# EAGLE schematic Resistor_Resistor (EAGLE 8.3.0), part 35 of 43
## Nets (continued)
N$94: R17001.2 R17002.2 R17003.2 R17004.2 R17005.2 R17006.2 R17007.2 R17008.2 R17009.2 R17010.2 R17011.2 R17012.2 R17013.2 R17014.2 R17015.2 R17016.2 R17017.2 R17018.2 R17019.2 R17020.2 R17021.2 R17022.2 R17023.2 R17024.2 R17025.2 R17026.2 R17027.2 R17028.2 R17029.2 R17030.2 R17031.2 R17032.2 R17033.2 R17034.2 R17035.2 R17036.2 R17037.2 R17038.2 R17039.2 R17040.2 R17041.2 R17042.2 R17043.2 R17044.2 R17045.2 R17046.2 R17047.2 R17048.2 R17049.2 R17050.2 R17051.2 R17052.2 R17053.2 R17054.2 R17055.2 R17056.2 R17057.2 R17058.2 R17059.2 R17060.2 R17061.2 R17062.2 R17063.2 R17064.2 R17065.2 R17066.2 R17067.2 R17068.2 R17069.2 R17070.2 R17071.2 R17072.2 R17073.2 R17074.2 R17075.2 R17076.2 R17077.2 R17078.2 R17079.2 R17080.2 R17081.2 R17082.2 R17083.2 R17084.2 R17085.2 R17086.2 R17087.2 R17088.2 R17089.2 R17090.2 R17091.2 R17092.2 R17093.2 R17094.2 R17095.2 R17096.2 R17097.2 R17098.2 R17099.2 R17100.2 R17101.2 R17102.2 R17103.2 R17104.2 R17105.2 R17106.2 R17107.2 R17108.2 R17109.2 R17110.2 R17111.2 R17112.2 R17113.2 R17114.2 R17115.2 R17116.2 R17117.2 R17118.2 R17119.2 R17120.2 R17121.2 R17122.2 R17123.2 R17124.2 R17125.2 R17126.2 R17127.2 R17128.2 R17129.2 R17130.2 R17131.2 R17132.2 R17133.2 R17134.2 R17135.2 R17136.2 R17137.2 R17138.2 R17139.2 R17140.2 R17141.2 R17142.2 R17143.2 R17144.2 R17145.2 R17146.2 R17147.2 R17148.2 R17149.2 R17150.2 R17151.2 R17152.2 R17153.2 R17154.2 R17155.2 R17156.2 R17157.2 R17158.2 R17159.2 R17160.2 R17161.2 R17162.2 R17163.2 R17164.2 R17165.2 R17166.2 R17167.2 R17168.2 R17169.2 R17170.2 R17171.2 R17172.2 R17173.2 R17174.2 R17175.2 R17176.2 R17177.2 R17178.2 R17179.2 R17180.2 R17181.2 R17182.2 R17183.2 R17184.2 R17185.2 R17186.2 R17187.2 R17188.2 R17189.2 R17190.2 R17191.2 R17192.2 R17193.2 R17194.2 R17195.2 R17196.2 R17197.2 R17198.2 R17199.2 R17200.2 R17201.1 R17202.1 R17203.1 R17204.1 R17205.1 R17206.1 R17207.1 R17208.1 R17209.1 R17210.1 R17211.1 R17212.1 R17213.1 R17214.1 R17215.1 R17216.1 R17217.1 R17218.1 R17219.1 R17220.1 R17221.1 R17222.1 R17223.1 R17224.1 R17225.1 R17226.1 R17227.1 R17228.1 R17229.1 R17230.1 R17231.1 R17232.1 R17233.1 R17234.1 R17235.1 R17236.1 R17237.1 R17238.1 R17239.1 R17240.1 R17241.1 R17242.1 R17243.1 R17244.1 R17245.1 R17246.1 R17247.1 R17248.1 R17249.1 R17250.1 R17251.1 R17252.1 R17253.1 R17254.1 R17255.1 R17256.1 R17257.1 R17258.1 R17259.1 R17260.1 R17261.1 R17262.1 R17263.1 R17264.1 R17265.1 R17266.1 R17267.1 R17268.1 R17269.1 R17270.1 R17271.1 R17272.1 R17273.1 R17274.1 R17275.1 R17276.1 R17277.1 R17278.1 R17279.1 R17280.1 R17281.1 R17282.1 R17283.1 R17284.1 R17285.1 R17286.1 R17287.1 R17288.1 R17289.1 R17290.1 R17291.1 R17292.1 R17293.1 R17294.1 R17295.1 R17296.1 R17297.1 R17298.1 R17299.1 R17300.1 R17301.1 R17302.1 R17303.1 R17304.1 R17305.1 R17306.1 R17307.1 R17308.1 R17309.1 R17310.1 R17311.1 R17312.1 R17313.1 R17314.1 R17315.1 R17316.1 R17317.1 R17318.1 R17319.1 R17320.1 R17321.1 R17322.1 R17323.1 R17324.1 R17325.1 R17326.1 R17327.1 R17328.1 R17329.1 R17330.1 R17331.1 R17332.1 R17333.1 R17334.1 R17335.1 R17336.1 R17337.1 R17338.1 R17339.1 R17340.1 R17341.1 R17342.1 R17343.1 R17344.1 R17345.1 R17346.1 R17347.1 R17348.1 R17349.1 R17350.1 R17351.1 R17352.1 R17353.1 R17354.1 R17355.1 R17356.1 R17357.1 R17358.1 R17359.1 R17360.1 R17361.1 R17362.1 R17363.1 R17364.1 R17365.1 R17366.1 R17367.1 R17368.1 R17369.1 R17370.1 R17371.1 R17372.1 R17373.1 R17374.1 R17375.1 R17376.1 R17377.1 R17378.1 R17379.1 R17380.1 R17381.1 R17382.1 R17383.1 R17384.1 R17385.1 R17386.1 R17387.1 R17388.1 R17389.1 R17390.1 R17391.1 R17392.1 R17393.1 R17394.1 R17395.1 R17396.1 R17397.1 R17398.1 R17399.1 R17400.1
N$95: R17201.2 R17202.2 R17203.2 R17204.2 R17205.2 R17206.2 R17207.2 R17208.2 R17209.2 R17210.2 R17211.2 R17212.2 R17213.2 R17214.2 R17215.2 R17216.2 R17217.2 R17218.2 R17219.2 R17220.2 R17221.2 R17222.2 R17223.2 R17224.2 R17225.2 R17226.2 R17227.2 R17228.2 R17229.2 R17230.2 R17231.2 R17232.2 R17233.2 R17234.2 R17235.2 R17236.2 R17237.2 R17238.2 R17239.2 R17240.2 R17241.2 R17242.2 R17243.2 R17244.2 R17245.2 R17246.2 R17247.2 R17248.2 R17249.2 R17250.2 R17251.2 R17252.2 R17253.2 R17254.2 R17255.2 R17256.2 R17257.2 R17258.2 R17259.2 R17260.2 R17261.2 R17262.2 R17263.2 R17264.2 R17265.2 R17266.2 R17267.2 R17268.2 R17269.2 R17270.2 R17271.2 R17272.2 R17273.2 R17274.2 R17275.2 R17276.2 R17277.2 R17278.2 R17279.2 R17280.2 R17281.2 R17282.2 R17283.2 R17284.2 R17285.2 R17286.2 R17287.2 R17288.2 R17289.2 R17290.2 R17291.2 R17292.2 R17293.2 R17294.2 R17295.2 R17296.2 R17297.2 R17298.2 R17299.2 R17300.2 R17301.2 R17302.2 R17303.2 R17304.2 R17305.2 R17306.2 R17307.2 R17308.2 R17309.2 R17310.2 R17311.2 R17312.2 R17313.2 R17314.2 R17315.2 R17316.2 R17317.2 R17318.2 R17319.2 R17320.2 R17321.2 R17322.2 R17323.2 R17324.2 R17325.2 R17326.2 R17327.2 R17328.2 R17329.2 R17330.2 R17331.2 R17332.2 R17333.2 R17334.2 R17335.2 R17336.2 R17337.2 R17338.2 R17339.2 R17340.2 R17341.2 R17342.2 R17343.2 R17344.2 R17345.2 R17346.2 R17347.2 R17348.2 R17349.2 R17350.2 R17351.2 R17352.2 R17353.2 R17354.2 R17355.2 R17356.2 R17357.2 R17358.2 R17359.2 R17360.2 R17361.2 R17362.2 R17363.2 R17364.2 R17365.2 R17366.2 R17367.2 R17368.2 R17369.2 R17370.2 R17371.2 R17372.2 R17373.2 R17374.2 R17375.2 R17376.2 R17377.2 R17378.2 R17379.2 R17380.2 R17381.2 R17382.2 R17383.2 R17384.2 R17385.2 R17386.2 R17387.2 R17388.2 R17389.2 R17390.2 R17391.2 R17392.2 R17393.2 R17394.2 R17395.2 R17396.2 R17397.2 R17398.2 R17399.2 R17400.2 R17401.1 R17402.1 R17403.1 R17404.1 R17405.1 R17406.1 R17407.1 R17408.1 R17409.1 R17410.1 R17411.1 R17412.1 R17413.1 R17414.1 R17415.1 R17416.1 R17417.1 R17418.1 R17419.1 R17420.1 R17421.1 R17422.1 R17423.1 R17424.1 R17425.1 R17426.1 R17427.1 R17428.1 R17429.1 R17430.1 R17431.1 R17432.1 R17433.1 R17434.1 R17435.1 R17436.1 R17437.1 R17438.1 R17439.1 R17440.1 R17441.1 R17442.1 R17443.1 R17444.1 R17445.1 R17446.1 R17447.1 R17448.1 R17449.1 R17450.1 R17451.1 R17452.1 R17453.1 R17454.1 R17455.1 R17456.1 R17457.1 R17458.1 R17459.1 R17460.1 R17461.1 R17462.1 R17463.1 R17464.1 R17465.1 R17466.1 R17467.1 R17468.1 R17469.1 R17470.1 R17471.1 R17472.1 R17473.1 R17474.1 R17475.1 R17476.1 R17477.1 R17478.1 R17479.1 R17480.1 R17481.1 R17482.1 R17483.1 R17484.1 R17485.1 R17486.1 R17487.1 R17488.1 R17489.1 R17490.1 R17491.1 R17492.1 R17493.1 R17494.1 R17495.1 R17496.1 R17497.1 R17498.1 R17499.1 R17500.1 R17501.1 R17502.1 R17503.1 R17504.1 R17505.1 R17506.1 R17507.1 R17508.1 R17509.1 R17510.1 R17511.1 R17512.1 R17513.1 R17514.1 R17515.1 R17516.1 R17517.1 R17518.1 R17519.1 R17520.1 R17521.1 R17522.1 R17523.1 R17524.1 R17525.1 R17526.1 R17527.1 R17528.1 R17529.1 R17530.1 R17531.1 R17532.1 R17533.1 R17534.1 R17535.1 R17536.1 R17537.1 R17538.1 R17539.1 R17540.1 R17541.1 R17542.1 R17543.1 R17544.1 R17545.1 R17546.1 R17547.1 R17548.1 R17549.1 R17550.1 R17551.1 R17552.1 R17553.1 R17554.1 R17555.1 R17556.1 R17557.1 R17558.1 R17559.1 R17560.1 R17561.1 R17562.1 R17563.1 R17564.1 R17565.1 R17566.1 R17567.1 R17568.1 R17569.1 R17570.1 R17571.1 R17572.1 R17573.1 R17574.1 R17575.1 R17576.1 R17577.1 R17578.1 R17579.1 R17580.1 R17581.1 R17582.1 R17583.1 R17584.1 R17585.1 R17586.1 R17587.1 R17588.1 R17589.1 R17590.1 R17591.1 R17592.1 R17593.1 R17594.1 R17595.1 R17596.1 R17597.1 R17598.1 R17599.1 R17600.1
N$96: R17401.2 R17402.2 R17403.2 R17404.2 R17405.2 R17406.2 R17407.2 R17408.2 R17409.2 R17410.2 R17411.2 R17412.2 R17413.2 R17414.2 R17415.2 R17416.2 R17417.2 R17418.2 R17419.2 R17420.2 R17421.2 R17422.2 R17423.2 R17424.2 R17425.2 R17426.2 R17427.2 R17428.2 R17429.2 R17430.2 R17431.2 R17432.2 R17433.2 R17434.2 R17435.2 R17436.2 R17437.2 R17438.2 R17439.2 R17440.2 R17441.2 R17442.2 R17443.2 R17444.2 R17445.2 R17446.2 R17447.2 R17448.2 R17449.2 R17450.2 R17451.2 R17452.2 R17453.2 R17454.2 R17455.2 R17456.2 R17457.2 R17458.2 R17459.2 R17460.2 R17461.2 R17462.2 R17463.2 R17464.2 R17465.2 R17466.2 R17467.2 R17468.2 R17469.2 R17470.2 R17471.2 R17472.2 R17473.2 R17474.2 R17475.2 R17476.2 R17477.2 R17478.2 R17479.2 R17480.2 R17481.2 R17482.2 R17483.2 R17484.2 R17485.2 R17486.2 R17487.2 R17488.2 R17489.2 R17490.2 R17491.2 R17492.2 R17493.2 R17494.2 R17495.2 R17496.2 R17497.2 R17498.2 R17499.2 R17500.2 R17501.2 R17502.2 R17503.2 R17504.2 R17505.2 R17506.2 R17507.2 R17508.2 R17509.2 R17510.2 R17511.2 R17512.2 R17513.2 R17514.2 R17515.2 R17516.2 R17517.2 R17518.2 R17519.2 R17520.2 R17521.2 R17522.2 R17523.2 R17524.2 R17525.2 R17526.2 R17527.2 R17528.2 R17529.2 R17530.2 R17531.2 R17532.2 R17533.2 R17534.2 R17535.2 R17536.2 R17537.2 R17538.2 R17539.2 R17540.2 R17541.2 R17542.2 R17543.2 R17544.2 R17545.2 R17546.2 R17547.2 R17548.2 R17549.2 R17550.2 R17551.2 R17552.2 R17553.2 R17554.2 R17555.2 R17556.2 R17557.2 R17558.2 R17559.2 R17560.2 R17561.2 R17562.2 R17563.2 R17564.2 R17565.2 R17566.2 R17567.2 R17568.2 R17569.2 R17570.2 R17571.2 R17572.2 R17573.2 R17574.2 R17575.2 R17576.2 R17577.2 R17578.2 R17579.2 R17580.2 R17581.2 R17582.2 R17583.2 R17584.2 R17585.2 R17586.2 R17587.2 R17588.2 R17589.2 R17590.2 R17591.2 R17592.2 R17593.2 R17594.2 R17595.2 R17596.2 R17597.2 R17598.2 R17599.2 R17600.2 R17601.1 R17602.1 R17603.1 R17604.1 R17605.1 R17606.1 R17607.1 R17608.1 R17609.1 R17610.1 R17611.1 R17612.1 R17613.1 R17614.1 R17615.1 R17616.1 R17617.1 R17618.1 R17619.1 R17620.1 R17621.1 R17622.1 R17623.1 R17624.1 R17625.1 R17626.1 R17627.1 R17628.1 R17629.1 R17630.1 R17631.1 R17632.1 R17633.1 R17634.1 R17635.1 R17636.1 R17637.1 R17638.1 R17639.1 R17640.1 R17641.1 R17642.1 R17643.1 R17644.1 R17645.1 R17646.1 R17647.1 R17648.1 R17649.1 R17650.1 R17651.1 R17652.1 R17653.1 R17654.1 R17655.1 R17656.1 R17657.1 R17658.1 R17659.1 R17660.1 R17661.1 R17662.1 R17663.1 R17664.1 R17665.1 R17666.1 R17667.1 R17668.1 R17669.1 R17670.1 R17671.1 R17672.1 R17673.1 R17674.1 R17675.1 R17676.1 R17677.1 R17678.1 R17679.1 R17680.1 R17681.1 R17682.1 R17683.1 R17684.1 R17685.1 R17686.1 R17687.1 R17688.1 R17689.1 R17690.1 R17691.1 R17692.1 R17693.1 R17694.1 R17695.1 R17696.1 R17697.1 R17698.1 R17699.1 R17700.1 R17701.1 R17702.1 R17703.1 R17704.1 R17705.1 R17706.1 R17707.1 R17708.1 R17709.1 R17710.1 R17711.1 R17712.1 R17713.1 R17714.1 R17715.1 R17716.1 R17717.1 R17718.1 R17719.1 R17720.1 R17721.1 R17722.1 R17723.1 R17724.1 R17725.1 R17726.1 R17727.1 R17728.1 R17729.1 R17730.1 R17731.1 R17732.1 R17733.1 R17734.1 R17735.1 R17736.1 R17737.1 R17738.1 R17739.1 R17740.1 R17741.1 R17742.1 R17743.1 R17744.1 R17745.1 R17746.1 R17747.1 R17748.1 R17749.1 R17750.1 R17751.1 R17752.1 R17753.1 R17754.1 R17755.1 R17756.1 R17757.1 R17758.1 R17759.1 R17760.1 R17761.1 R17762.1 R17763.1 R17764.1 R17765.1 R17766.1 R17767.1 R17768.1 R17769.1 R17770.1 R17771.1 R17772.1 R17773.1 R17774.1 R17775.1 R17776.1 R17777.1 R17778.1 R17779.1 R17780.1 R17781.1 R17782.1 R17783.1 R17784.1 R17785.1 R17786.1 R17787.1 R17788.1 R17789.1 R17790.1 R17791.1 R17792.1 R17793.1 R17794.1 R17795.1 R17796.1 R17797.1 R17798.1 R17799.1 R17800.1
N$97: R17601.2 R17602.2 R17603.2 R17604.2 R17605.2 R17606.2 R17607.2 R17608.2 R17609.2 R17610.2 R17611.2 R17612.2 R17613.2 R17614.2 R17615.2 R17616.2 R17617.2 R17618.2 R17619.2 R17620.2 R17621.2 R17622.2 R17623.2 R17624.2 R17625.2 R17626.2 R17627.2 R17628.2 R17629.2 R17630.2 R17631.2 R17632.2 R17633.2 R17634.2 R17635.2 R17636.2 R17637.2 R17638.2 R17639.2 R17640.2 R17641.2 R17642.2 R17643.2 R17644.2 R17645.2 R17646.2 R17647.2 R17648.2 R17649.2 R17650.2 R17651.2 R17652.2 R17653.2 R17654.2 R17655.2 R17656.2 R17657.2 R17658.2 R17659.2 R17660.2 R17661.2 R17662.2 R17663.2 R17664.2 R17665.2 R17666.2 R17667.2 R17668.2 R17669.2 R17670.2 R17671.2 R17672.2 R17673.2 R17674.2 R17675.2 R17676.2 R17677.2 R17678.2 R17679.2 R17680.2 R17681.2 R17682.2 R17683.2 R17684.2 R17685.2 R17686.2 R17687.2 R17688.2 R17689.2 R17690.2 R17691.2 R17692.2 R17693.2 R17694.2 R17695.2 R17696.2 R17697.2 R17698.2 R17699.2 R17700.2 R17701.2 R17702.2 R17703.2 R17704.2 R17705.2 R17706.2 R17707.2 R17708.2 R17709.2 R17710.2 R17711.2 R17712.2 R17713.2 R17714.2 R17715.2 R17716.2 R17717.2 R17718.2 R17719.2 R17720.2 R17721.2 R17722.2 R17723.2 R17724.2 R17725.2 R17726.2 R17727.2 R17728.2 R17729.2 R17730.2 R17731.2 R17732.2 R17733.2 R17734.2 R17735.2 R17736.2 R17737.2 R17738.2 R17739.2 R17740.2 R17741.2 R17742.2 R17743.2 R17744.2 R17745.2 R17746.2 R17747.2 R17748.2 R17749.2 R17750.2 R17751.2 R17752.2 R17753.2 R17754.2 R17755.2 R17756.2 R17757.2 R17758.2 R17759.2 R17760.2 R17761.2 R17762.2 R17763.2 R17764.2 R17765.2 R17766.2 R17767.2 R17768.2 R17769.2 R17770.2 R17771.2 R17772.2 R17773.2 R17774.2 R17775.2 R17776.2 R17777.2 R17778.2 R17779.2 R17780.2 R17781.2 R17782.2 R17783.2 R17784.2 R17785.2 R17786.2 R17787.2 R17788.2 R17789.2 R17790.2 R17791.2 R17792.2 R17793.2 R17794.2 R17795.2 R17796.2 R17797.2 R17798.2 R17799.2 R17800.2 R17801.1 R17802.1 R17803.1 R17804.1 R17805.1 R17806.1 R17807.1 R17808.1 R17809.1 R17810.1 R17811.1 R17812.1 R17813.1 R17814.1 R17815.1 R17816.1 R17817.1 R17818.1 R17819.1 R17820.1 R17821.1 R17822.1 R17823.1 R17824.1 R17825.1 R17826.1 R17827.1 R17828.1 R17829.1 R17830.1 R17831.1 R17832.1 R17833.1 R17834.1 R17835.1 R17836.1 R17837.1 R17838.1 R17839.1 R17840.1 R17841.1 R17842.1 R17843.1 R17844.1 R17845.1 R17846.1 R17847.1 R17848.1 R17849.1 R17850.1 R17851.1 R17852.1 R17853.1 R17854.1 R17855.1 R17856.1 R17857.1 R17858.1 R17859.1 R17860.1 R17861.1 R17862.1 R17863.1 R17864.1 R17865.1 R17866.1 R17867.1 R17868.1 R17869.1 R17870.1 R17871.1 R17872.1 R17873.1 R17874.1 R17875.1 R17876.1 R17877.1 R17878.1 R17879.1 R17880.1 R17881.1 R17882.1 R17883.1 R17884.1 R17885.1 R17886.1 R17887.1 R17888.1 R17889.1 R17890.1 R17891.1 R17892.1 R17893.1 R17894.1 R17895.1 R17896.1 R17897.1 R17898.1 R17899.1 R17900.1 R17901.1 R17902.1 R17903.1 R17904.1 R17905.1 R17906.1 R17907.1 R17908.1 R17909.1 R17910.1 R17911.1 R17912.1 R17913.1 R17914.1 R17915.1 R17916.1 R17917.1 R17918.1 R17919.1 R17920.1 R17921.1 R17922.1 R17923.1 R17924.1 R17925.1 R17926.1 R17927.1 R17928.1 R17929.1 R17930.1 R17931.1 R17932.1 R17933.1 R17934.1 R17935.1 R17936.1 R17937.1 R17938.1 R17939.1 R17940.1 R17941.1 R17942.1 R17943.1 R17944.1 R17945.1 R17946.1 R17947.1 R17948.1 R17949.1 R17950.1 R17951.1 R17952.1 R17953.1 R17954.1 R17955.1 R17956.1 R17957.1 R17958.1 R17959.1 R17960.1 R17961.1 R17962.1 R17963.1 R17964.1 R17965.1 R17966.1 R17967.1 R17968.1 R17969.1 R17970.1 R17971.1 R17972.1 R17973.1 R17974.1 R17975.1 R17976.1 R17977.1 R17978.1 R17979.1 R17980.1 R17981.1 R17982.1 R17983.1 R17984.1 R17985.1 R17986.1 R17987.1 R17988.1 R17989.1 R17990.1 R17991.1 R17992.1 R17993.1 R17994.1 R17995.1 R17996.1 R17997.1 R17998.1 R17999.1 R18000.1
N$98: R17801.2 R17802.2 R17803.2 R17804.2 R17805.2 R17806.2 R17807.2 R17808.2 R17809.2 R17810.2 R17811.2 R17812.2 R17813.2 R17814.2 R17815.2 R17816.2 R17817.2 R17818.2 R17819.2 R17820.2 R17821.2 R17822.2 R17823.2 R17824.2 R17825.2 R17826.2 R17827.2 R17828.2 R17829.2 R17830.2 R17831.2 R17832.2 R17833.2 R17834.2 R17835.2 R17836.2 R17837.2 R17838.2 R17839.2 R17840.2 R17841.2 R17842.2 R17843.2 R17844.2 R17845.2 R17846.2 R17847.2 R17848.2 R17849.2 R17850.2 R17851.2 R17852.2 R17853.2 R17854.2 R17855.2 R17856.2 R17857.2 R17858.2 R17859.2 R17860.2 R17861.2 R17862.2 R17863.2 R17864.2 R17865.2 R17866.2 R17867.2 R17868.2 R17869.2 R17870.2 R17871.2 R17872.2 R17873.2 R17874.2 R17875.2 R17876.2 R17877.2 R17878.2 R17879.2 R17880.2 R17881.2 R17882.2 R17883.2 R17884.2 R17885.2 R17886.2 R17887.2 R17888.2 R17889.2 R17890.2 R17891.2 R17892.2 R17893.2 R17894.2 R17895.2 R17896.2 R17897.2 R17898.2 R17899.2 R17900.2 R17901.2 R17902.2 R17903.2 R17904.2 R17905.2 R17906.2 R17907.2 R17908.2 R17909.2 R17910.2 R17911.2 R17912.2 R17913.2 R17914.2 R17915.2 R17916.2 R17917.2 R17918.2 R17919.2 R17920.2 R17921.2 R17922.2 R17923.2 R17924.2 R17925.2 R17926.2 R17927.2 R17928.2 R17929.2 R17930.2 R17931.2 R17932.2 R17933.2 R17934.2 R17935.2 R17936.2 R17937.2 R17938.2 R17939.2 R17940.2 R17941.2 R17942.2 R17943.2 R17944.2 R17945.2 R17946.2 R17947.2 R17948.2 R17949.2 R17950.2 R17951.2 R17952.2 R17953.2 R17954.2 R17955.2 R17956.2 R17957.2 R17958.2 R17959.2 R17960.2 R17961.2 R17962.2 R17963.2 R17964.2 R17965.2 R17966.2 R17967.2 R17968.2 R17969.2 R17970.2 R17971.2 R17972.2 R17973.2 R17974.2 R17975.2 R17976.2 R17977.2 R17978.2 R17979.2 R17980.2 R17981.2 R17982.2 R17983.2 R17984.2 R17985.2 R17986.2 R17987.2 R17988.2 R17989.2 R17990.2 R17991.2 R17992.2 R17993.2 R17994.2 R17995.2 R17996.2 R17997.2 R17998.2 R17999.2 R18000.2 R18001.1 R18002.1 R18003.1 R18004.1 R18005.1 R18006.1 R18007.1 R18008.1 R18009.1 R18010.1 R18011.1 R18012.1 R18013.1 R18014.1 R18015.1 R18016.1 R18017.1 R18018.1 R18019.1 R18020.1 R18021.1 R18022.1 R18023.1 R18024.1 R18025.1 R18026.1 R18027.1 R18028.1 R18029.1 R18030.1 R18031.1 R18032.1 R18033.1 R18034.1 R18035.1 R18036.1 R18037.1 R18038.1 R18039.1 R18040.1 R18041.1 R18042.1 R18043.1 R18044.1 R18045.1 R18046.1 R18047.1 R18048.1 R18049.1 R18050.1 R18051.1 R18052.1 R18053.1 R18054.1 R18055.1 R18056.1 R18057.1 R18058.1 R18059.1 R18060.1 R18061.1 R18062.1 R18063.1 R18064.1 R18065.1 R18066.1 R18067.1 R18068.1 R18069.1 R18070.1 R18071.1 R18072.1 R18073.1 R18074.1 R18075.1 R18076.1 R18077.1 R18078.1 R18079.1 R18080.1 R18081.1 R18082.1 R18083.1 R18084.1 R18085.1 R18086.1 R18087.1 R18088.1 R18089.1 R18090.1 R18091.1 R18092.1 R18093.1 R18094.1 R18095.1 R18096.1 R18097.1 R18098.1 R18099.1 R18100.1 R18101.1 R18102.1 R18103.1 R18104.1 R18105.1 R18106.1 R18107.1 R18108.1 R18109.1 R18110.1 R18111.1 R18112.1 R18113.1 R18114.1 R18115.1 R18116.1 R18117.1 R18118.1 R18119.1 R18120.1 R18121.1 R18122.1 R18123.1 R18124.1 R18125.1 R18126.1 R18127.1 R18128.1 R18129.1 R18130.1 R18131.1 R18132.1 R18133.1 R18134.1 R18135.1 R18136.1 R18137.1 R18138.1 R18139.1 R18140.1 R18141.1 R18142.1 R18143.1 R18144.1 R18145.1 R18146.1 R18147.1 R18148.1 R18149.1 R18150.1 R18151.1 R18152.1 R18153.1 R18154.1 R18155.1 R18156.1 R18157.1 R18158.1 R18159.1 R18160.1 R18161.1 R18162.1 R18163.1 R18164.1 R18165.1 R18166.1 R18167.1 R18168.1 R18169.1 R18170.1 R18171.1 R18172.1 R18173.1 R18174.1 R18175.1 R18176.1 R18177.1 R18178.1 R18179.1 R18180.1 R18181.1 R18182.1 R18183.1 R18184.1 R18185.1 R18186.1 R18187.1 R18188.1 R18189.1 R18190.1 R18191.1 R18192.1 R18193.1 R18194.1 R18195.1 R18196.1 R18197.1 R18198.1 R18199.1 R18200.1
N$99: R18001.2 R18002.2 R18003.2 R18004.2 R18005.2 R18006.2 R18007.2 R18008.2 R18009.2 R18010.2 R18011.2 R18012.2 R18013.2 R18014.2 R18015.2 R18016.2 R18017.2 R18018.2 R18019.2 R18020.2 R18021.2 R18022.2 R18023.2 R18024.2 R18025.2 R18026.2 R18027.2 R18028.2 R18029.2 R18030.2 R18031.2 R18032.2 R18033.2 R18034.2 R18035.2 R18036.2 R18037.2 R18038.2 R18039.2 R18040.2 R18041.2 R18042.2 R18043.2 R18044.2 R18045.2 R18046.2 R18047.2 R18048.2 R18049.2 R18050.2 R18051.2 R18052.2 R18053.2 R18054.2 R18055.2 R18056.2 R18057.2 R18058.2 R18059.2 R18060.2 R18061.2 R18062.2 R18063.2 R18064.2 R18065.2 R18066.2 R18067.2 R18068.2 R18069.2 R18070.2 R18071.2 R18072.2 R18073.2 R18074.2 R18075.2 R18076.2 R18077.2 R18078.2 R18079.2 R18080.2 R18081.2 R18082.2 R18083.2 R18084.2 R18085.2 R18086.2 R18087.2 R18088.2 R18089.2 R18090.2 R18091.2 R18092.2 R18093.2 R18094.2 R18095.2 R18096.2 R18097.2 R18098.2 R18099.2 R18100.2 R18101.2 R18102.2 R18103.2 R18104.2 R18105.2 R18106.2 R18107.2 R18108.2 R18109.2 R18110.2 R18111.2 R18112.2 R18113.2 R18114.2 R18115.2 R18116.2 R18117.2 R18118.2 R18119.2 R18120.2 R18121.2 R18122.2 R18123.2 R18124.2 R18125.2 R18126.2 R18127.2 R18128.2 R18129.2 R18130.2 R18131.2 R18132.2 R18133.2 R18134.2 R18135.2 R18136.2 R18137.2 R18138.2 R18139.2 R18140.2 R18141.2 R18142.2 R18143.2 R18144.2 R18145.2 R18146.2 R18147.2 R18148.2 R18149.2 R18150.2 R18151.2 R18152.2 R18153.2 R18154.2 R18155.2 R18156.2 R18157.2 R18158.2 R18159.2 R18160.2 R18161.2 R18162.2 R18163.2 R18164.2 R18165.2 R18166.2 R18167.2 R18168.2 R18169.2 R18170.2 R18171.2 R18172.2 R18173.2 R18174.2 R18175.2 R18176.2 R18177.2 R18178.2 R18179.2 R18180.2 R18181.2 R18182.2 R18183.2 R18184.2 R18185.2 R18186.2 R18187.2 R18188.2 R18189.2 R18190.2 R18191.2 R18192.2 R18193.2 R18194.2 R18195.2 R18196.2 R18197.2 R18198.2 R18199.2 R18200.2 R18201.1 R18202.1 R18203.1 R18204.1 R18205.1 R18206.1 R18207.1 R18208.1 R18209.1 R18210.1 R18211.1 R18212.1 R18213.1 R18214.1 R18215.1 R18216.1 R18217.1 R18218.1 R18219.1 R18220.1 R18221.1 R18222.1 R18223.1 R18224.1 R18225.1 R18226.1 R18227.1 R18228.1 R18229.1 R18230.1 R18231.1 R18232.1 R18233.1 R18234.1 R18235.1 R18236.1 R18237.1 R18238.1 R18239.1 R18240.1 R18241.1 R18242.1 R18243.1 R18244.1 R18245.1 R18246.1 R18247.1 R18248.1 R18249.1 R18250.1 R18251.1 R18252.1 R18253.1 R18254.1 R18255.1 R18256.1 R18257.1 R18258.1 R18259.1 R18260.1 R18261.1 R18262.1 R18263.1 R18264.1 R18265.1 R18266.1 R18267.1 R18268.1 R18269.1 R18270.1 R18271.1 R18272.1 R18273.1 R18274.1 R18275.1 R18276.1 R18277.1 R18278.1 R18279.1 R18280.1 R18281.1 R18282.1 R18283.1 R18284.1 R18285.1 R18286.1 R18287.1 R18288.1 R18289.1 R18290.1 R18291.1 R18292.1 R18293.1 R18294.1 R18295.1 R18296.1 R18297.1 R18298.1 R18299.1 R18300.1 R18301.1 R18302.1 R18303.1 R18304.1 R18305.1 R18306.1 R18307.1 R18308.1 R18309.1 R18310.1 R18311.1 R18312.1 R18313.1 R18314.1 R18315.1 R18316.1 R18317.1 R18318.1 R18319.1 R18320.1 R18321.1 R18322.1 R18323.1 R18324.1 R18325.1 R18326.1 R18327.1 R18328.1 R18329.1 R18330.1 R18331.1 R18332.1 R18333.1 R18334.1 R18335.1 R18336.1 R18337.1 R18338.1 R18339.1 R18340.1 R18341.1 R18342.1 R18343.1 R18344.1 R18345.1 R18346.1 R18347.1 R18348.1 R18349.1 R18350.1 R18351.1 R18352.1 R18353.1 R18354.1 R18355.1 R18356.1 R18357.1 R18358.1 R18359.1 R18360.1 R18361.1 R18362.1 R18363.1 R18364.1 R18365.1 R18366.1 R18367.1 R18368.1 R18369.1 R18370.1 R18371.1 R18372.1 R18373.1 R18374.1 R18375.1 R18376.1 R18377.1 R18378.1 R18379.1 R18380.1 R18381.1 R18382.1 R18383.1 R18384.1 R18385.1 R18386.1 R18387.1 R18388.1 R18389.1 R18390.1 R18391.1 R18392.1 R18393.1 R18394.1 R18395.1 R18396.1 R18397.1 R18398.1 R18399.1 R18400.1
N$100: R18201.2 R18202.2 R18203.2 R18204.2 R18205.2 R18206.2 R18207.2 R18208.2 R18209.2 R18210.2 R18211.2 R18212.2 R18213.2 R18214.2 R18215.2 R18216.2 R18217.2 R18218.2 R18219.2 R18220.2 R18221.2 R18222.2 R18223.2 R18224.2 R18225.2 R18226.2 R18227.2 R18228.2 R18229.2 R18230.2 R18231.2 R18232.2 R18233.2 R18234.2 R18235.2 R18236.2 R18237.2 R18238.2 R18239.2 R18240.2 R18241.2 R18242.2 R18243.2 R18244.2 R18245.2 R18246.2 R18247.2 R18248.2 R18249.2 R18250.2 R18251.2 R18252.2 R18253.2 R18254.2 R18255.2 R18256.2 R18257.2 R18258.2 R18259.2 R18260.2 R18261.2 R18262.2 R18263.2 R18264.2 R18265.2 R18266.2 R18267.2 R18268.2 R18269.2 R18270.2 R18271.2 R18272.2 R18273.2 R18274.2 R18275.2 R18276.2 R18277.2 R18278.2 R18279.2 R18280.2 R18281.2 R18282.2 R18283.2 R18284.2 R18285.2 R18286.2 R18287.2 R18288.2 R18289.2 R18290.2 R18291.2 R18292.2 R18293.2 R18294.2 R18295.2 R18296.2 R18297.2 R18298.2 R18299.2 R18300.2 R18301.2 R18302.2 R18303.2 R18304.2 R18305.2 R18306.2 R18307.2 R18308.2 R18309.2 R18310.2 R18311.2 R18312.2 R18313.2 R18314.2 R18315.2 R18316.2 R18317.2 R18318.2 R18319.2 R18320.2 R18321.2 R18322.2 R18323.2 R18324.2 R18325.2 R18326.2 R18327.2 R18328.2 R18329.2 R18330.2 R18331.2 R18332.2 R18333.2 R18334.2 R18335.2 R18336.2 R18337.2 R18338.2 R18339.2 R18340.2 R18341.2 R18342.2 R18343.2 R18344.2 R18345.2 R18346.2 R18347.2 R18348.2 R18349.2 R18350.2 R18351.2 R18352.2 R18353.2 R18354.2 R18355.2 R18356.2 R18357.2 R18358.2 R18359.2 R18360.2 R18361.2 R18362.2 R18363.2 R18364.2 R18365.2 R18366.2 R18367.2 R18368.2 R18369.2 R18370.2 R18371.2 R18372.2 R18373.2 R18374.2 R18375.2 R18376.2 R18377.2 R18378.2 R18379.2 R18380.2 R18381.2 R18382.2 R18383.2 R18384.2 R18385.2 R18386.2 R18387.2 R18388.2 R18389.2 R18390.2 R18391.2 R18392.2 R18393.2 R18394.2 R18395.2 R18396.2 R18397.2 R18398.2 R18399.2 R18400.2 R18401.1 R18402.1 R18403.1 R18404.1 R18405.1 R18406.1 R18407.1 R18408.1 R18409.1 R18410.1 R18411.1 R18412.1 R18413.1 R18414.1 R18415.1 R18416.1 R18417.1 R18418.1 R18419.1 R18420.1 R18421.1 R18422.1 R18423.1 R18424.1 R18425.1 R18426.1 R18427.1 R18428.1 R18429.1 R18430.1 R18431.1 R18432.1 R18433.1 R18434.1 R18435.1 R18436.1 R18437.1 R18438.1 R18439.1 R18440.1 R18441.1 R18442.1 R18443.1 R18444.1 R18445.1 R18446.1 R18447.1 R18448.1 R18449.1 R18450.1 R18451.1 R18452.1 R18453.1 R18454.1 R18455.1 R18456.1 R18457.1 R18458.1 R18459.1 R18460.1 R18461.1 R18462.1 R18463.1 R18464.1 R18465.1 R18466.1 R18467.1 R18468.1 R18469.1 R18470.1 R18471.1 R18472.1 R18473.1 R18474.1 R18475.1 R18476.1 R18477.1 R18478.1 R18479.1 R18480.1 R18481.1 R18482.1 R18483.1 R18484.1 R18485.1 R18486.1 R18487.1 R18488.1 R18489.1 R18490.1 R18491.1 R18492.1 R18493.1 R18494.1 R18495.1 R18496.1 R18497.1 R18498.1 R18499.1 R18500.1 R18501.1 R18502.1 R18503.1 R18504.1 R18505.1 R18506.1 R18507.1 R18508.1 R18509.1 R18510.1 R18511.1 R18512.1 R18513.1 R18514.1 R18515.1 R18516.1 R18517.1 R18518.1 R18519.1 R18520.1 R18521.1 R18522.1 R18523.1 R18524.1 R18525.1 R18526.1 R18527.1 R18528.1 R18529.1 R18530.1 R18531.1 R18532.1 R18533.1 R18534.1 R18535.1 R18536.1 R18537.1 R18538.1 R18539.1 R18540.1 R18541.1 R18542.1 R18543.1 R18544.1 R18545.1 R18546.1 R18547.1 R18548.1 R18549.1 R18550.1 R18551.1 R18552.1 R18553.1 R18554.1 R18555.1 R18556.1 R18557.1 R18558.1 R18559.1 R18560.1 R18561.1 R18562.1 R18563.1 R18564.1 R18565.1 R18566.1 R18567.1 R18568.1 R18569.1 R18570.1 R18571.1 R18572.1 R18573.1 R18574.1 R18575.1 R18576.1 R18577.1 R18578.1 R18579.1 R18580.1 R18581.1 R18582.1 R18583.1 R18584.1 R18585.1 R18586.1 R18587.1 R18588.1 R18589.1 R18590.1 R18591.1 R18592.1 R18593.1 R18594.1 R18595.1 R18596.1 R18597.1 R18598.1 R18599.1 R18600.1
N$101: R18401.2 R18402.2 R18403.2 R18404.2 R18405.2 R18406.2 R18407.2 R18408.2 R18409.2 R18410.2 R18411.2 R18412.2 R18413.2 R18414.2 R18415.2 R18416.2 R18417.2 R18418.2 R18419.2 R18420.2 R18421.2 R18422.2 R18423.2 R18424.2 R18425.2 R18426.2 R18427.2 R18428.2 R18429.2 R18430.2 R18431.2 R18432.2 R18433.2 R18434.2 R18435.2 R18436.2 R18437.2 R18438.2 R18439.2 R18440.2 R18441.2 R18442.2 R18443.2 R18444.2 R18445.2 R18446.2 R18447.2 R18448.2 R18449.2 R18450.2 R18451.2 R18452.2 R18453.2 R18454.2 R18455.2 R18456.2 R18457.2 R18458.2 R18459.2 R18460.2 R18461.2 R18462.2 R18463.2 R18464.2 R18465.2 R18466.2 R18467.2 R18468.2 R18469.2 R18470.2 R18471.2 R18472.2 R18473.2 R18474.2 R18475.2 R18476.2 R18477.2 R18478.2 R18479.2 R18480.2 R18481.2 R18482.2 R18483.2 R18484.2 R18485.2 R18486.2 R18487.2 R18488.2 R18489.2 R18490.2 R18491.2 R18492.2 R18493.2 R18494.2 R18495.2 R18496.2 R18497.2 R18498.2 R18499.2 R18500.2 R18501.2 R18502.2 R18503.2 R18504.2 R18505.2 R18506.2 R18507.2 R18508.2 R18509.2 R18510.2 R18511.2 R18512.2 R18513.2 R18514.2 R18515.2 R18516.2 R18517.2 R18518.2 R18519.2 R18520.2 R18521.2 R18522.2 R18523.2 R18524.2 R18525.2 R18526.2 R18527.2 R18528.2 R18529.2 R18530.2 R18531.2 R18532.2 R18533.2 R18534.2 R18535.2 R18536.2 R18537.2 R18538.2 R18539.2 R18540.2 R18541.2 R18542.2 R18543.2 R18544.2 R18545.2 R18546.2 R18547.2 R18548.2 R18549.2 R18550.2 R18551.2 R18552.2 R18553.2 R18554.2 R18555.2 R18556.2 R18557.2 R18558.2 R18559.2 R18560.2 R18561.2 R18562.2 R18563.2 R18564.2 R18565.2 R18566.2 R18567.2 R18568.2 R18569.2 R18570.2 R18571.2 R18572.2 R18573.2 R18574.2 R18575.2 R18576.2 R18577.2 R18578.2 R18579.2 R18580.2 R18581.2 R18582.2 R18583.2 R18584.2 R18585.2 R18586.2 R18587.2 R18588.2 R18589.2 R18590.2 R18591.2 R18592.2 R18593.2 R18594.2 R18595.2 R18596.2 R18597.2 R18598.2 R18599.2 R18600.2 R18601.1 R18602.1 R18603.1 R18604.1 R18605.1 R18606.1 R18607.1 R18608.1 R18609.1 R18610.1 R18611.1 R18612.1 R18613.1 R18614.1 R18615.1 R18616.1 R18617.1 R18618.1 R18619.1 R18620.1 R18621.1 R18622.1 R18623.1 R18624.1 R18625.1 R18626.1 R18627.1 R18628.1 R18629.1 R18630.1 R18631.1 R18632.1 R18633.1 R18634.1 R18635.1 R18636.1 R18637.1 R18638.1 R18639.1 R18640.1 R18641.1 R18642.1 R18643.1 R18644.1 R18645.1 R18646.1 R18647.1 R18648.1 R18649.1 R18650.1 R18651.1 R18652.1 R18653.1 R18654.1 R18655.1 R18656.1 R18657.1 R18658.1 R18659.1 R18660.1 R18661.1 R18662.1 R18663.1 R18664.1 R18665.1 R18666.1 R18667.1 R18668.1 R18669.1 R18670.1 R18671.1 R18672.1 R18673.1 R18674.1 R18675.1 R18676.1 R18677.1 R18678.1 R18679.1 R18680.1 R18681.1 R18682.1 R18683.1 R18684.1 R18685.1 R18686.1 R18687.1 R18688.1 R18689.1 R18690.1 R18691.1 R18692.1 R18693.1 R18694.1 R18695.1 R18696.1 R18697.1 R18698.1 R18699.1 R18700.1 R18701.1 R18702.1 R18703.1 R18704.1 R18705.1 R18706.1 R18707.1 R18708.1 R18709.1 R18710.1 R18711.1 R18712.1 R18713.1 R18714.1 R18715.1 R18716.1 R18717.1 R18718.1 R18719.1 R18720.1 R18721.1 R18722.1 R18723.1 R18724.1 R18725.1 R18726.1 R18727.1 R18728.1 R18729.1 R18730.1 R18731.1 R18732.1 R18733.1 R18734.1 R18735.1 R18736.1 R18737.1 R18738.1 R18739.1 R18740.1 R18741.1 R18742.1 R18743.1 R18744.1 R18745.1 R18746.1 R18747.1 R18748.1 R18749.1 R18750.1 R18751.1 R18752.1 R18753.1 R18754.1 R18755.1 R18756.1 R18757.1 R18758.1 R18759.1 R18760.1 R18761.1 R18762.1 R18763.1 R18764.1 R18765.1 R18766.1 R18767.1 R18768.1 R18769.1 R18770.1 R18771.1 R18772.1 R18773.1 R18774.1 R18775.1 R18776.1 R18777.1 R18778.1 R18779.1 R18780.1 R18781.1 R18782.1 R18783.1 R18784.1 R18785.1 R18786.1 R18787.1 R18788.1 R18789.1 R18790.1 R18791.1 R18792.1 R18793.1 R18794.1 R18795.1 R18796.1 R18797.1 R18798.1 R18799.1 R18800.1
N$102: R18601.2 R18602.2 R18603.2 R18604.2 R18605.2 R18606.2 R18607.2 R18608.2 R18609.2 R18610.2 R18611.2 R18612.2 R18613.2 R18614.2 R18615.2 R18616.2 R18617.2 R18618.2 R18619.2 R18620.2 R18621.2 R18622.2 R18623.2 R18624.2 R18625.2 R18626.2 R18627.2 R18628.2 R18629.2 R18630.2 R18631.2 R18632.2 R18633.2 R18634.2 R18635.2 R18636.2 R18637.2 R18638.2 R18639.2 R18640.2 R18641.2 R18642.2 R18643.2 R18644.2 R18645.2 R18646.2 R18647.2 R18648.2 R18649.2 R18650.2 R18651.2 R18652.2 R18653.2 R18654.2 R18655.2 R18656.2 R18657.2 R18658.2 R18659.2 R18660.2 R18661.2 R18662.2 R18663.2 R18664.2 R18665.2 R18666.2 R18667.2 R18668.2 R18669.2 R18670.2 R18671.2 R18672.2 R18673.2 R18674.2 R18675.2 R18676.2 R18677.2 R18678.2 R18679.2 R18680.2 R18681.2 R18682.2 R18683.2 R18684.2 R18685.2 R18686.2 R18687.2 R18688.2 R18689.2 R18690.2 R18691.2 R18692.2 R18693.2 R18694.2 R18695.2 R18696.2 R18697.2 R18698.2 R18699.2 R18700.2 R18701.2 R18702.2 R18703.2 R18704.2 R18705.2 R18706.2 R18707.2 R18708.2 R18709.2 R18710.2 R18711.2 R18712.2 R18713.2 R18714.2 R18715.2 R18716.2 R18717.2 R18718.2 R18719.2 R18720.2 R18721.2 R18722.2 R18723.2 R18724.2 R18725.2 R18726.2 R18727.2 R18728.2 R18729.2 R18730.2 R18731.2 R18732.2 R18733.2 R18734.2 R18735.2 R18736.2 R18737.2 R18738.2 R18739.2 R18740.2 R18741.2 R18742.2 R18743.2 R18744.2 R18745.2 R18746.2 R18747.2 R18748.2 R18749.2 R18750.2 R18751.2 R18752.2 R18753.2 R18754.2 R18755.2 R18756.2 R18757.2 R18758.2 R18759.2 R18760.2 R18761.2 R18762.2 R18763.2 R18764.2 R18765.2 R18766.2 R18767.2 R18768.2 R18769.2 R18770.2 R18771.2 R18772.2 R18773.2 R18774.2 R18775.2 R18776.2 R18777.2 R18778.2 R18779.2 R18780.2 R18781.2 R18782.2 R18783.2 R18784.2 R18785.2 R18786.2 R18787.2 R18788.2 R18789.2 R18790.2 R18791.2 R18792.2 R18793.2 R18794.2 R18795.2 R18796.2 R18797.2 R18798.2 R18799.2 R18800.2 R18801.1 R18802.1 R18803.1 R18804.1 R18805.1 R18806.1 R18807.1 R18808.1 R18809.1 R18810.1 R18811.1 R18812.1 R18813.1 R18814.1 R18815.1 R18816.1 R18817.1 R18818.1 R18819.1 R18820.1 R18821.1 R18822.1 R18823.1 R18824.1 R18825.1 R18826.1 R18827.1 R18828.1 R18829.1 R18830.1 R18831.1 R18832.1 R18833.1 R18834.1 R18835.1 R18836.1 R18837.1 R18838.1 R18839.1 R18840.1 R18841.1 R18842.1 R18843.1 R18844.1 R18845.1 R18846.1 R18847.1 R18848.1 R18849.1 R18850.1 R18851.1 R18852.1 R18853.1 R18854.1 R18855.1 R18856.1 R18857.1 R18858.1 R18859.1 R18860.1 R18861.1 R18862.1 R18863.1 R18864.1 R18865.1 R18866.1 R18867.1 R18868.1 R18869.1 R18870.1 R18871.1 R18872.1 R18873.1 R18874.1 R18875.1 R18876.1 R18877.1 R18878.1 R18879.1 R18880.1 R18881.1 R18882.1 R18883.1 R18884.1 R18885.1 R18886.1 R18887.1 R18888.1 R18889.1 R18890.1 R18891.1 R18892.1 R18893.1 R18894.1 R18895.1 R18896.1 R18897.1 R18898.1 R18899.1 R18900.1 R18901.1 R18902.1 R18903.1 R18904.1 R18905.1 R18906.1 R18907.1 R18908.1 R18909.1 R18910.1 R18911.1 R18912.1 R18913.1 R18914.1 R18915.1 R18916.1 R18917.1 R18918.1 R18919.1 R18920.1 R18921.1 R18922.1 R18923.1 R18924.1 R18925.1 R18926.1 R18927.1 R18928.1 R18929.1 R18930.1 R18931.1 R18932.1 R18933.1 R18934.1 R18935.1 R18936.1 R18937.1 R18938.1 R18939.1 R18940.1 R18941.1 R18942.1 R18943.1 R18944.1 R18945.1 R18946.1 R18947.1 R18948.1 R18949.1 R18950.1 R18951.1 R18952.1 R18953.1 R18954.1 R18955.1 R18956.1 R18957.1 R18958.1 R18959.1 R18960.1 R18961.1 R18962.1 R18963.1 R18964.1 R18965.1 R18966.1 R18967.1 R18968.1 R18969.1 R18970.1 R18971.1 R18972.1 R18973.1 R18974.1 R18975.1 R18976.1 R18977.1 R18978.1 R18979.1 R18980.1 R18981.1 R18982.1 R18983.1 R18984.1 R18985.1 R18986.1 R18987.1 R18988.1 R18989.1 R18990.1 R18991.1 R18992.1 R18993.1 R18994.1 R18995.1 R18996.1 R18997.1 R18998.1 R18999.1 R19000.1
N$103: R18801.2 R18802.2 R18803.2 R18804.2 R18805.2 R18806.2 R18807.2 R18808.2 R18809.2 R18810.2 R18811.2 R18812.2 R18813.2 R18814.2 R18815.2 R18816.2 R18817.2 R18818.2 R18819.2 R18820.2 R18821.2 R18822.2 R18823.2 R18824.2 R18825.2 R18826.2 R18827.2 R18828.2 R18829.2 R18830.2 R18831.2 R18832.2 R18833.2 R18834.2 R18835.2 R18836.2 R18837.2 R18838.2 R18839.2 R18840.2 R18841.2 R18842.2 R18843.2 R18844.2 R18845.2 R18846.2 R18847.2 R18848.2 R18849.2 R18850.2 R18851.2 R18852.2 R18853.2 R18854.2 R18855.2 R18856.2 R18857.2 R18858.2 R18859.2 R18860.2 R18861.2 R18862.2 R18863.2 R18864.2 R18865.2 R18866.2 R18867.2 R18868.2 R18869.2 R18870.2 R18871.2 R18872.2 R18873.2 R18874.2 R18875.2 R18876.2 R18877.2 R18878.2 R18879.2 R18880.2 R18881.2 R18882.2 R18883.2 R18884.2 R18885.2 R18886.2 R18887.2 R18888.2 R18889.2 R18890.2 R18891.2 R18892.2 R18893.2 R18894.2 R18895.2 R18896.2 R18897.2 R18898.2 R18899.2 R18900.2 R18901.2 R18902.2 R18903.2 R18904.2 R18905.2 R18906.2 R18907.2 R18908.2 R18909.2 R18910.2 R18911.2 R18912.2 R18913.2 R18914.2 R18915.2 R18916.2 R18917.2 R18918.2 R18919.2 R18920.2 R18921.2 R18922.2 R18923.2 R18924.2 R18925.2 R18926.2 R18927.2 R18928.2 R18929.2 R18930.2 R18931.2 R18932.2 R18933.2 R18934.2 R18935.2 R18936.2 R18937.2 R18938.2 R18939.2 R18940.2 R18941.2 R18942.2 R18943.2 R18944.2 R18945.2 R18946.2 R18947.2 R18948.2 R18949.2 R18950.2 R18951.2 R18952.2 R18953.2 R18954.2 R18955.2 R18956.2 R18957.2 R18958.2 R18959.2 R18960.2 R18961.2 R18962.2 R18963.2 R18964.2 R18965.2 R18966.2 R18967.2 R18968.2 R18969.2 R18970.2 R18971.2 R18972.2 R18973.2 R18974.2 R18975.2 R18976.2 R18977.2 R18978.2 R18979.2 R18980.2 R18981.2 R18982.2 R18983.2 R18984.2 R18985.2 R18986.2 R18987.2 R18988.2 R18989.2 R18990.2 R18991.2 R18992.2 R18993.2 R18994.2 R18995.2 R18996.2 R18997.2 R18998.2 R18999.2 R19000.2 R19001.1 R19002.1 R19003.1 R19004.1 R19005.1 R19006.1 R19007.1 R19008.1 R19009.1 R19010.1 R19011.1 R19012.1 R19013.1 R19014.1 R19015.1 R19016.1 R19017.1 R19018.1 R19019.1 R19020.1 R19021.1 R19022.1 R19023.1 R19024.1 R19025.1 R19026.1 R19027.1 R19028.1 R19029.1 R19030.1 R19031.1 R19032.1 R19033.1 R19034.1 R19035.1 R19036.1 R19037.1 R19038.1 R19039.1 R19040.1 R19041.1 R19042.1 R19043.1 R19044.1 R19045.1 R19046.1 R19047.1 R19048.1 R19049.1 R19050.1 R19051.1 R19052.1 R19053.1 R19054.1 R19055.1 R19056.1 R19057.1 R19058.1 R19059.1 R19060.1 R19061.1 R19062.1 R19063.1 R19064.1 R19065.1 R19066.1 R19067.1 R19068.1 R19069.1 R19070.1 R19071.1 R19072.1 R19073.1 R19074.1 R19075.1 R19076.1 R19077.1 R19078.1 R19079.1 R19080.1 R19081.1 R19082.1 R19083.1 R19084.1 R19085.1 R19086.1 R19087.1 R19088.1 R19089.1 R19090.1 R19091.1 R19092.1 R19093.1 R19094.1 R19095.1 R19096.1 R19097.1 R19098.1 R19099.1 R19100.1 R19101.1 R19102.1 R19103.1 R19104.1 R19105.1 R19106.1 R19107.1 R19108.1 R19109.1 R19110.1 R19111.1 R19112.1 R19113.1 R19114.1 R19115.1 R19116.1 R19117.1 R19118.1 R19119.1 R19120.1 R19121.1 R19122.1 R19123.1 R19124.1 R19125.1 R19126.1 R19127.1 R19128.1 R19129.1 R19130.1 R19131.1 R19132.1 R19133.1 R19134.1 R19135.1 R19136.1 R19137.1 R19138.1 R19139.1 R19140.1 R19141.1 R19142.1 R19143.1 R19144.1 R19145.1 R19146.1 R19147.1 R19148.1 R19149.1 R19150.1 R19151.1 R19152.1 R19153.1 R19154.1 R19155.1 R19156.1 R19157.1 R19158.1 R19159.1 R19160.1 R19161.1 R19162.1 R19163.1 R19164.1 R19165.1 R19166.1 R19167.1 R19168.1 R19169.1 R19170.1 R19171.1 R19172.1 R19173.1 R19174.1 R19175.1 R19176.1 R19177.1 R19178.1 R19179.1 R19180.1 R19181.1 R19182.1 R19183.1 R19184.1 R19185.1 R19186.1 R19187.1 R19188.1 R19189.1 R19190.1 R19191.1 R19192.1 R19193.1 R19194.1 R19195.1 R19196.1 R19197.1 R19198.1 R19199.1 R19200.1
N$104: R19001.2 R19002.2 R19003.2 R19004.2 R19005.2 R19006.2 R19007.2 R19008.2 R19009.2 R19010.2 R19011.2 R19012.2 R19013.2 R19014.2 R19015.2 R19016.2 R19017.2 R19018.2 R19019.2 R19020.2 R19021.2 R19022.2 R19023.2 R19024.2 R19025.2 R19026.2 R19027.2 R19028.2 R19029.2 R19030.2 R19031.2 R19032.2 R19033.2 R19034.2 R19035.2 R19036.2 R19037.2 R19038.2 R19039.2 R19040.2 R19041.2 R19042.2 R19043.2 R19044.2 R19045.2 R19046.2 R19047.2 R19048.2 R19049.2 R19050.2 R19051.2 R19052.2 R19053.2 R19054.2 R19055.2 R19056.2 R19057.2 R19058.2 R19059.2 R19060.2 R19061.2 R19062.2 R19063.2 R19064.2 R19065.2 R19066.2 R19067.2 R19068.2 R19069.2 R19070.2 R19071.2 R19072.2 R19073.2 R19074.2 R19075.2 R19076.2 R19077.2 R19078.2 R19079.2 R19080.2 R19081.2 R19082.2 R19083.2 R19084.2 R19085.2 R19086.2 R19087.2 R19088.2 R19089.2 R19090.2 R19091.2 R19092.2 R19093.2 R19094.2 R19095.2 R19096.2 R19097.2 R19098.2 R19099.2 R19100.2 R19101.2 R19102.2 R19103.2 R19104.2 R19105.2 R19106.2 R19107.2 R19108.2 R19109.2 R19110.2 R19111.2 R19112.2 R19113.2 R19114.2 R19115.2 R19116.2 R19117.2 R19118.2 R19119.2 R19120.2 R19121.2 R19122.2 R19123.2 R19124.2 R19125.2 R19126.2 R19127.2 R19128.2 R19129.2 R19130.2 R19131.2 R19132.2 R19133.2 R19134.2 R19135.2 R19136.2 R19137.2 R19138.2 R19139.2 R19140.2 R19141.2 R19142.2 R19143.2 R19144.2 R19145.2 R19146.2 R19147.2 R19148.2 R19149.2 R19150.2 R19151.2 R19152.2 R19153.2 R19154.2 R19155.2 R19156.2 R19157.2 R19158.2 R19159.2 R19160.2 R19161.2 R19162.2 R19163.2 R19164.2 R19165.2 R19166.2 R19167.2 R19168.2 R19169.2 R19170.2 R19171.2 R19172.2 R19173.2 R19174.2 R19175.2 R19176.2 R19177.2 R19178.2 R19179.2 R19180.2 R19181.2 R19182.2 R19183.2 R19184.2 R19185.2 R19186.2 R19187.2 R19188.2 R19189.2 R19190.2 R19191.2 R19192.2 R19193.2 R19194.2 R19195.2 R19196.2 R19197.2 R19198.2 R19199.2 R19200.2 R19201.1 R19202.1 R19203.1 R19204.1 R19205.1 R19206.1 R19207.1 R19208.1 R19209.1 R19210.1 R19211.1 R19212.1 R19213.1 R19214.1 R19215.1 R19216.1 R19217.1 R19218.1 R19219.1 R19220.1 R19221.1 R19222.1 R19223.1 R19224.1 R19225.1 R19226.1 R19227.1 R19228.1 R19229.1 R19230.1 R19231.1 R19232.1 R19233.1 R19234.1 R19235.1 R19236.1 R19237.1 R19238.1 R19239.1 R19240.1 R19241.1 R19242.1 R19243.1 R19244.1 R19245.1 R19246.1 R19247.1 R19248.1 R19249.1 R19250.1 R19251.1 R19252.1 R19253.1 R19254.1 R19255.1 R19256.1 R19257.1 R19258.1 R19259.1 R19260.1 R19261.1 R19262.1 R19263.1 R19264.1 R19265.1 R19266.1 R19267.1 R19268.1 R19269.1 R19270.1 R19271.1 R19272.1 R19273.1 R19274.1 R19275.1 R19276.1 R19277.1 R19278.1 R19279.1 R19280.1 R19281.1 R19282.1 R19283.1 R19284.1 R19285.1 R19286.1 R19287.1 R19288.1 R19289.1 R19290.1 R19291.1 R19292.1 R19293.1 R19294.1 R19295.1 R19296.1 R19297.1 R19298.1 R19299.1 R19300.1 R19301.1 R19302.1 R19303.1 R19304.1 R19305.1 R19306.1 R19307.1 R19308.1 R19309.1 R19310.1 R19311.1 R19312.1 R19313.1 R19314.1 R19315.1 R19316.1 R19317.1 R19318.1 R19319.1 R19320.1 R19321.1 R19322.1 R19323.1 R19324.1 R19325.1 R19326.1 R19327.1 R19328.1 R19329.1 R19330.1 R19331.1 R19332.1 R19333.1 R19334.1 R19335.1 R19336.1 R19337.1 R19338.1 R19339.1 R19340.1 R19341.1 R19342.1 R19343.1 R19344.1 R19345.1 R19346.1 R19347.1 R19348.1 R19349.1 R19350.1 R19351.1 R19352.1 R19353.1 R19354.1 R19355.1 R19356.1 R19357.1 R19358.1 R19359.1 R19360.1 R19361.1 R19362.1 R19363.1 R19364.1 R19365.1 R19366.1 R19367.1 R19368.1 R19369.1 R19370.1 R19371.1 R19372.1 R19373.1 R19374.1 R19375.1 R19376.1 R19377.1 R19378.1 R19379.1 R19380.1 R19381.1 R19382.1 R19383.1 R19384.1 R19385.1 R19386.1 R19387.1 R19388.1 R19389.1 R19390.1 R19391.1 R19392.1 R19393.1 R19394.1 R19395.1 R19396.1 R19397.1 R19398.1 R19399.1 R19400.1
N$105: R19201.2 R19202.2 R19203.2 R19204.2 R19205.2 R19206.2 R19207.2 R19208.2 R19209.2 R19210.2 R19211.2 R19212.2 R19213.2 R19214.2 R19215.2 R19216.2 R19217.2 R19218.2 R19219.2 R19220.2 R19221.2 R19222.2 R19223.2 R19224.2 R19225.2 R19226.2 R19227.2 R19228.2 R19229.2 R19230.2 R19231.2 R19232.2 R19233.2 R19234.2 R19235.2 R19236.2 R19237.2 R19238.2 R19239.2 R19240.2 R19241.2 R19242.2 R19243.2 R19244.2 R19245.2 R19246.2 R19247.2 R19248.2 R19249.2 R19250.2 R19251.2 R19252.2 R19253.2 R19254.2 R19255.2 R19256.2 R19257.2 R19258.2 R19259.2 R19260.2 R19261.2 R19262.2 R19263.2 R19264.2 R19265.2 R19266.2 R19267.2 R19268.2 R19269.2 R19270.2 R19271.2 R19272.2 R19273.2 R19274.2 R19275.2 R19276.2 R19277.2 R19278.2 R19279.2 R19280.2 R19281.2 R19282.2 R19283.2 R19284.2 R19285.2 R19286.2 R19287.2 R19288.2 R19289.2 R19290.2 R19291.2 R19292.2 R19293.2 R19294.2 R19295.2 R19296.2 R19297.2 R19298.2 R19299.2 R19300.2 R19301.2 R19302.2 R19303.2 R19304.2 R19305.2 R19306.2 R19307.2 R19308.2 R19309.2 R19310.2 R19311.2 R19312.2 R19313.2 R19314.2 R19315.2 R19316.2 R19317.2 R19318.2 R19319.2 R19320.2 R19321.2 R19322.2 R19323.2 R19324.2 R19325.2 R19326.2 R19327.2 R19328.2 R19329.2 R19330.2 R19331.2 R19332.2 R19333.2 R19334.2 R19335.2 R19336.2 R19337.2 R19338.2 R19339.2 R19340.2 R19341.2 R19342.2 R19343.2 R19344.2 R19345.2 R19346.2 R19347.2 R19348.2 R19349.2 R19350.2 R19351.2 R19352.2 R19353.2 R19354.2 R19355.2 R19356.2 R19357.2 R19358.2 R19359.2 R19360.2 R19361.2 R19362.2 R19363.2 R19364.2 R19365.2 R19366.2 R19367.2 R19368.2 R19369.2 R19370.2 R19371.2 R19372.2 R19373.2 R19374.2 R19375.2 R19376.2 R19377.2 R19378.2 R19379.2 R19380.2 R19381.2 R19382.2 R19383.2 R19384.2 R19385.2 R19386.2 R19387.2 R19388.2 R19389.2 R19390.2 R19391.2 R19392.2 R19393.2 R19394.2 R19395.2 R19396.2 R19397.2 R19398.2 R19399.2 R19400.2 R19401.1 R19402.1 R19403.1 R19404.1 R19405.1 R19406.1 R19407.1 R19408.1 R19409.1 R19410.1 R19411.1 R19412.1 R19413.1 R19414.1 R19415.1 R19416.1 R19417.1 R19418.1 R19419.1 R19420.1 R19421.1 R19422.1 R19423.1 R19424.1 R19425.1 R19426.1 R19427.1 R19428.1 R19429.1 R19430.1 R19431.1 R19432.1 R19433.1 R19434.1 R19435.1 R19436.1 R19437.1 R19438.1 R19439.1 R19440.1 R19441.1 R19442.1 R19443.1 R19444.1 R19445.1 R19446.1 R19447.1 R19448.1 R19449.1 R19450.1 R19451.1 R19452.1 R19453.1 R19454.1 R19455.1 R19456.1 R19457.1 R19458.1 R19459.1 R19460.1 R19461.1 R19462.1 R19463.1 R19464.1 R19465.1 R19466.1 R19467.1 R19468.1 R19469.1 R19470.1 R19471.1 R19472.1 R19473.1 R19474.1 R19475.1 R19476.1 R19477.1 R19478.1 R19479.1 R19480.1 R19481.1 R19482.1 R19483.1 R19484.1 R19485.1 R19486.1 R19487.1 R19488.1 R19489.1 R19490.1 R19491.1 R19492.1 R19493.1 R19494.1 R19495.1 R19496.1 R19497.1 R19498.1 R19499.1 R19500.1 R19501.1 R19502.1 R19503.1 R19504.1 R19505.1 R19506.1 R19507.1 R19508.1 R19509.1 R19510.1 R19511.1 R19512.1 R19513.1 R19514.1 R19515.1 R19516.1 R19517.1 R19518.1 R19519.1 R19520.1 R19521.1 R19522.1 R19523.1 R19524.1 R19525.1 R19526.1 R19527.1 R19528.1 R19529.1 R19530.1 R19531.1 R19532.1 R19533.1 R19534.1 R19535.1 R19536.1 R19537.1 R19538.1 R19539.1 R19540.1 R19541.1 R19542.1 R19543.1 R19544.1 R19545.1 R19546.1 R19547.1 R19548.1 R19549.1 R19550.1 R19551.1 R19552.1 R19553.1 R19554.1 R19555.1 R19556.1 R19557.1 R19558.1 R19559.1 R19560.1 R19561.1 R19562.1 R19563.1 R19564.1 R19565.1 R19566.1 R19567.1 R19568.1 R19569.1 R19570.1 R19571.1 R19572.1 R19573.1 R19574.1 R19575.1 R19576.1 R19577.1 R19578.1 R19579.1 R19580.1 R19581.1 R19582.1 R19583.1 R19584.1 R19585.1 R19586.1 R19587.1 R19588.1 R19589.1 R19590.1 R19591.1 R19592.1 R19593.1 R19594.1 R19595.1 R19596.1 R19597.1 R19598.1 R19599.1 R19600.1
N$106: R19401.2 R19402.2 R19403.2 R19404.2 R19405.2 R19406.2 R19407.2 R19408.2 R19409.2 R19410.2 R19411.2 R19412.2 R19413.2 R19414.2 R19415.2 R19416.2 R19417.2 R19418.2 R19419.2 R19420.2 R19421.2 R19422.2 R19423.2 R19424.2 R19425.2 R19426.2 R19427.2 R19428.2 R19429.2 R19430.2 R19431.2 R19432.2 R19433.2 R19434.2 R19435.2 R19436.2 R19437.2 R19438.2 R19439.2 R19440.2 R19441.2 R19442.2 R19443.2 R19444.2 R19445.2 R19446.2 R19447.2 R19448.2 R19449.2 R19450.2 R19451.2 R19452.2 R19453.2 R19454.2 R19455.2 R19456.2 R19457.2 R19458.2 R19459.2 R19460.2 R19461.2 R19462.2 R19463.2 R19464.2 R19465.2 R19466.2 R19467.2 R19468.2 R19469.2 R19470.2 R19471.2 R19472.2 R19473.2 R19474.2 R19475.2 R19476.2 R19477.2 R19478.2 R19479.2 R19480.2 R19481.2 R19482.2 R19483.2 R19484.2 R19485.2 R19486.2 R19487.2 R19488.2 R19489.2 R19490.2 R19491.2 R19492.2 R19493.2 R19494.2 R19495.2 R19496.2 R19497.2 R19498.2 R19499.2 R19500.2 R19501.2 R19502.2 R19503.2 R19504.2 R19505.2 R19506.2 R19507.2 R19508.2 R19509.2 R19510.2 R19511.2 R19512.2 R19513.2 R19514.2 R19515.2 R19516.2 R19517.2 R19518.2 R19519.2 R19520.2 R19521.2 R19522.2 R19523.2 R19524.2 R19525.2 R19526.2 R19527.2 R19528.2 R19529.2 R19530.2 R19531.2 R19532.2 R19533.2 R19534.2 R19535.2 R19536.2 R19537.2 R19538.2 R19539.2 R19540.2 R19541.2 R19542.2 R19543.2 R19544.2 R19545.2 R19546.2 R19547.2 R19548.2 R19549.2 R19550.2 R19551.2 R19552.2 R19553.2 R19554.2 R19555.2 R19556.2 R19557.2 R19558.2 R19559.2 R19560.2 R19561.2 R19562.2 R19563.2 R19564.2 R19565.2 R19566.2 R19567.2 R19568.2 R19569.2 R19570.2 R19571.2 R19572.2 R19573.2 R19574.2 R19575.2 R19576.2 R19577.2 R19578.2 R19579.2 R19580.2 R19581.2 R19582.2 R19583.2 R19584.2 R19585.2 R19586.2 R19587.2 R19588.2 R19589.2 R19590.2 R19591.2 R19592.2 R19593.2 R19594.2 R19595.2 R19596.2 R19597.2 R19598.2 R19599.2 R19600.2 R19601.1 R19602.1 R19603.1 R19604.1 R19605.1 R19606.1 R19607.1 R19608.1 R19609.1 R19610.1 R19611.1 R19612.1 R19613.1 R19614.1 R19615.1 R19616.1 R19617.1 R19618.1 R19619.1 R19620.1 R19621.1 R19622.1 R19623.1 R19624.1 R19625.1 R19626.1 R19627.1 R19628.1 R19629.1 R19630.1 R19631.1 R19632.1 R19633.1 R19634.1 R19635.1 R19636.1 R19637.1 R19638.1 R19639.1 R19640.1 R19641.1 R19642.1 R19643.1 R19644.1 R19645.1 R19646.1 R19647.1 R19648.1 R19649.1 R19650.1 R19651.1 R19652.1 R19653.1 R19654.1 R19655.1 R19656.1 R19657.1 R19658.1 R19659.1 R19660.1 R19661.1 R19662.1 R19663.1 R19664.1 R19665.1 R19666.1 R19667.1 R19668.1 R19669.1 R19670.1 R19671.1 R19672.1 R19673.1 R19674.1 R19675.1 R19676.1 R19677.1 R19678.1 R19679.1 R19680.1 R19681.1 R19682.1 R19683.1 R19684.1 R19685.1 R19686.1 R19687.1 R19688.1 R19689.1 R19690.1 R19691.1 R19692.1 R19693.1 R19694.1 R19695.1 R19696.1 R19697.1 R19698.1 R19699.1 R19700.1 R19701.1 R19702.1 R19703.1 R19704.1 R19705.1 R19706.1 R19707.1 R19708.1 R19709.1 R19710.1 R19711.1 R19712.1 R19713.1 R19714.1 R19715.1 R19716.1 R19717.1 R19718.1 R19719.1 R19720.1 R19721.1 R19722.1 R19723.1 R19724.1 R19725.1 R19726.1 R19727.1 R19728.1 R19729.1 R19730.1 R19731.1 R19732.1 R19733.1 R19734.1 R19735.1 R19736.1 R19737.1 R19738.1 R19739.1 R19740.1 R19741.1 R19742.1 R19743.1 R19744.1 R19745.1 R19746.1 R19747.1 R19748.1 R19749.1 R19750.1 R19751.1 R19752.1 R19753.1 R19754.1 R19755.1 R19756.1 R19757.1 R19758.1 R19759.1 R19760.1 R19761.1 R19762.1 R19763.1 R19764.1 R19765.1 R19766.1 R19767.1 R19768.1 R19769.1 R19770.1 R19771.1 R19772.1 R19773.1 R19774.1 R19775.1 R19776.1 R19777.1 R19778.1 R19779.1 R19780.1 R19781.1 R19782.1 R19783.1 R19784.1 R19785.1 R19786.1 R19787.1 R19788.1 R19789.1 R19790.1 R19791.1 R19792.1 R19793.1 R19794.1 R19795.1 R19796.1 R19797.1 R19798.1 R19799.1 R19800.1